# EasyEDA Pro project balance_car.eprj, schematic Schematic1
Board Name: 1_控制板_2; Create Date: 2024-08-28; Page Name: P1; Project Name: balance_car; Schematic Name: Schematic1_2; Update Date: 2024-08-28
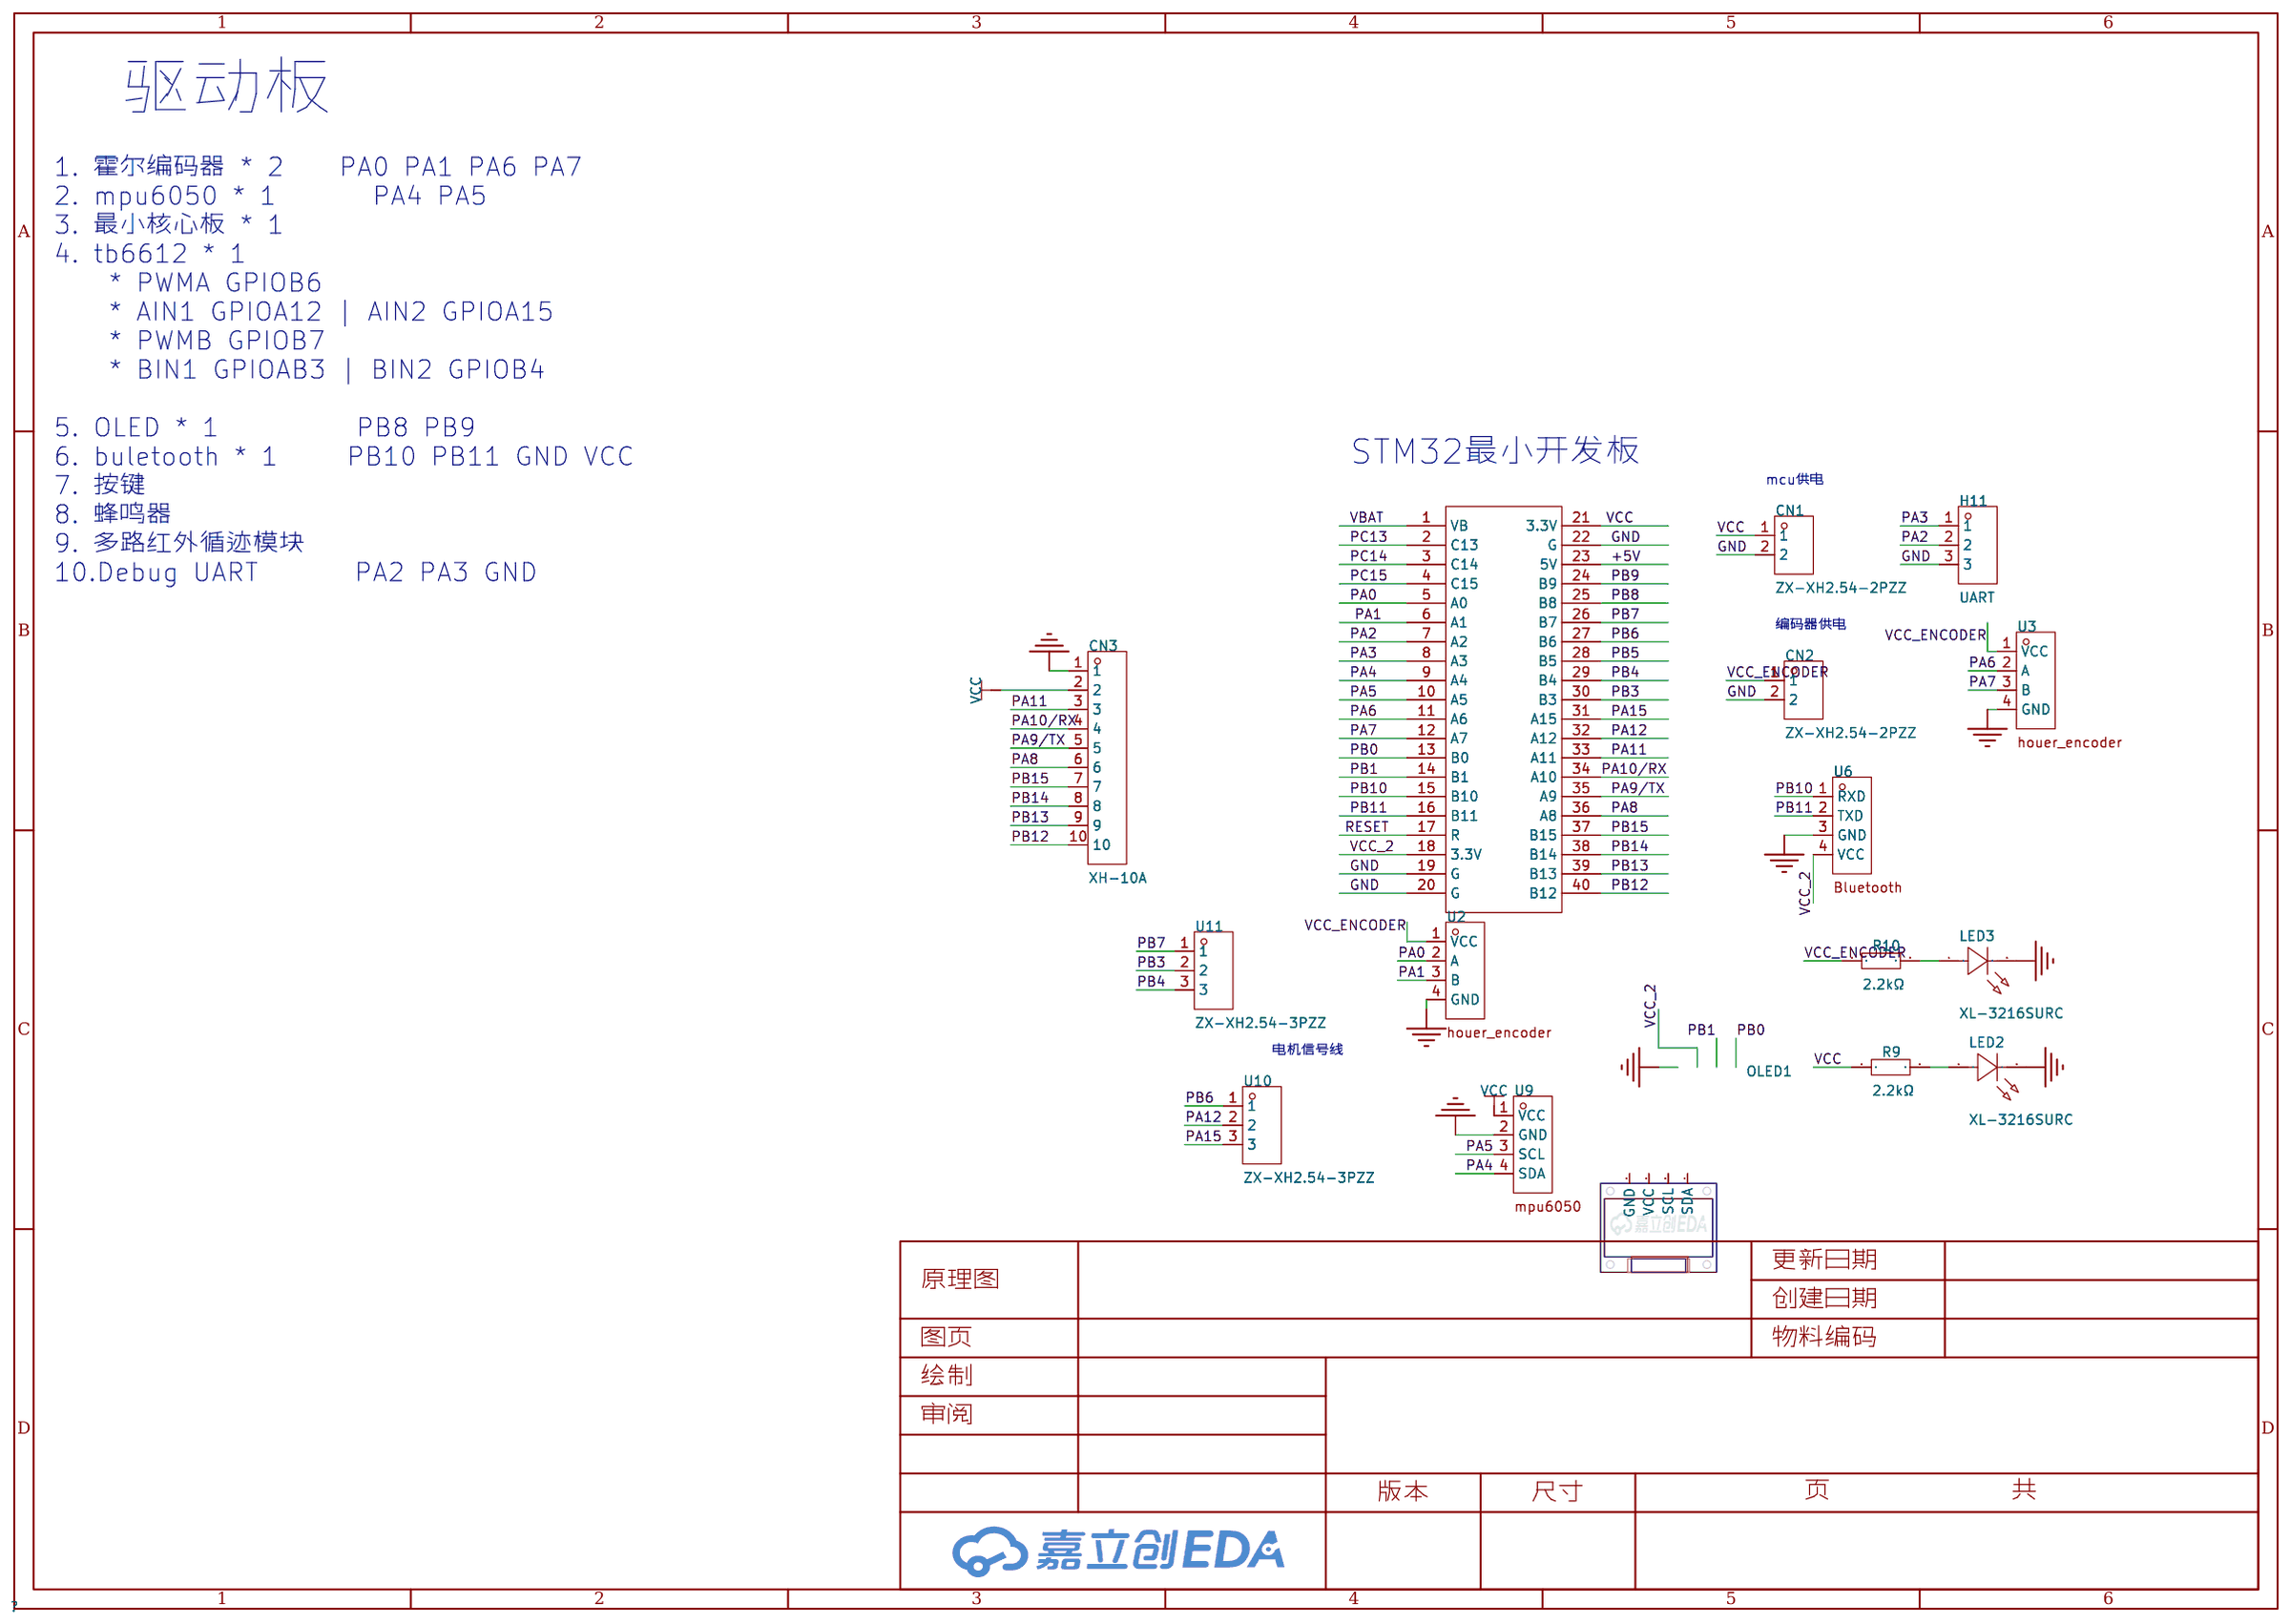
[diagram p3: schematic sheet]

## Parts
CN1  ZX-XH2.54-2PZZ  [CONN-TH_2P-P2.50_HX25003-2A]
CN2  ZX-XH2.54-2PZZ  [CONN-TH_2P-P2.50_HX25003-2A]
CN3  XH-10A  [CONN-TH_10P-P2.50_HCTL_XH-10A]
H11  UART  [HDR-TH_3P-P2.54-V-M]
LED2  XL-3216SURC  [LED1206-R-RD_RED]
LED3  XL-3216SURC  [LED1206-R-RD_RED]
OLED1  -  [0.96OLED_4P]
R9  2.2kΩ  [R0805]
R10  2.2kΩ  [R0805]
S  -  [stm32最小开发板]
U2  -  [houer_encoder]
U3  -  [houer_encoder]
U6  -  [bluetooth]
U9  -  [mpu6050_1]
U10  ZX-XH2.54-3PZZ  [CONN-TH_3P-P2.54_2501S-3P]
U11  ZX-XH2.54-3PZZ  [CONN-TH_3P-P2.54_2501S-3P]

## Library data of the parts
CN1 CN2 = ZX-XH2.54-2PZZ: 插针结构:1x2P;间距:2.54mm;安装方式:直插;参考系列:XH;总PIN数:2P;排数:1;每排PIN数:2;行距:-;额定电流:3A;触头材质:黄铜;触头镀层:锡;工作温度范围:-25℃~+85℃;; Supplier Part: C7429632; Manufacturer: Megastar(兆星); Supplier Footprint: 插件,P=2.54mm; JLCPCB Part Class: 扩展库; Datasheet: https://atta.szlcsc.com/upload/public/pdf/source/20230619/19BA6947230AA44A04D3EDD65E618FD0.pdf; Supplier: LCSC; Pins Structure: 1x2P; Pitch: 2.54mm; Mounting Style: 直插; Reference Series: XH; Number of Pins: 2P; Number of Rows: 1; Number of PINs Per Row: 2; Current Rating (Max): 3A; Contact Material: 黄铜; Contact Plating: 锡; Operating Temperature Range: -25℃~+85℃
CN3 = XH-10A: LCSC Part Name: 1x10P 间距:2.5mm 直插 系列:XH; Supplier Part: C2908608; Manufacturer: HCTL(华灿天禄); Supplier Footprint: 插件,P=2.5mm; JLCPCB Part Class: 扩展库; Datasheet: https://atta.szlcsc.com/upload/public/pdf/source/20230711/68D365716984B4AFE576D1D73D61B465.pdf; Supplier: LCSC; Pins Structure: 1x10P; Pitch: 2.5mm; Mounting Style: 直插; Reference Series: XH; Number of Pins: 10P; Number of Rows: 1; Number of PINs Per Row: 10; Current Rating (Max): 3A; Contact Material: 黄铜; Contact Plating: 锡; Operating Temperature Range: -25℃~+85℃
H11 = PZ254V-11-03P: 插针结构:1x3P;间距:2.54mm;行距:-;圆针/方针:方针;安装类型:直插;排数:单排;总PIN位数:3P;额定电流:3A;额定电压:250V;配合针长度:6mm;塑高:2.5mm;端接针长度:3mm;工作温度范围:-40℃~+105℃;颜色:黑色;; LCSC Part Name: 间距:2.54mm 1x3P 直插 方针; Supplier Part: C2937625; Manufacturer: XFCN(兴飞); Supplier Footprint: 插件,P=2.54mm; JLCPCB Part Class: 扩展库; Datasheet: https://atta.szlcsc.com/upload/public/pdf/source/20200309/C492402_8335C3D49C4E4C618838D59BB1D024C1.pdf; Supplier: LCSC; Pin Structure: 1x3P; Pitch: 2.54mm; Circluar Pins/Square Pins: 方针; Mounting Type: 直插; Number of Rows: 单排; Number of Pins: 3P; Current Rating (Max): 3A; Voltage Rating (Max): 250V; Length of Mating Pin: 6mm; Insulation Height: 2.5mm; Length of End Connection Pin: 3mm; Operating Temperature Range: -40℃~+105℃; Color: 黑色
LED2 LED3 = XL-3216SURC: Supplier Part: C965822; Manufacturer: XINGLIGHT(成兴光); Supplier Footprint: 1206; JLCPCB Part Class: 扩展库; Datasheet: https://atta.szlcsc.com/upload/public/pdf/source/20221102/38B682A5E5FDBBFCA7077B6272CE8E6F.pdf; Supplier: LCSC; Emitted Color: 红色; Power Dissipation: 55mW; Forward Current: 25mA; Dominant Wavelength: 617nm~621nm; Peak Wavelength: 623nm; Lens Color: 无色透明透镜; Viewing Angle: 120°; Mounting Sytle: 正贴; Operating Temperature: -30℃~+85℃
OLED1 = 0.96OLED模块_4P: Supplier Footprint: 插件
R9 R10 = 0805W8F2201T5E: 阻值:2.2kΩ;精度:±1%;功率:125mW;温度系数:±100ppm/℃;电阻类型:厚膜电阻;; LCSC Part Name: 2.2kΩ ±1% 125mW 厚膜电阻; Supplier Part: C17520; Manufacturer: UNI-ROYAL(厚声); Supplier Footprint: 0805; JLCPCB Part Class: 基础库; Datasheet: https://atta.szlcsc.com/upload/public/pdf/source/20200306/C422600_1E6D84923E4A46A82E41ADD87F860B5C.pdf; Supplier: LCSC; Tolerance: ±1%; Power(Watts): 125mW; Overload Voltage (Max): 150V; Temperature Coefficient: ±100ppm/℃; Type: 厚膜电阻; Operating Temperature Range: -55℃~+155℃
S = Stm32最小开发板
U2 U3 = huoer_encoder
U6 = bluetooth
U9 = mpu6050_1
U10 U11 = ZX-XH2.54-3PZZ: 插针结构:1x3P;间距:2.54mm;安装方式:直插;参考系列:XH;总PIN数:3P;排数:1;每排PIN数:3;行距:-;额定电流:3A;触头材质:黄铜;触头镀层:锡;工作温度范围:-25℃~+85℃;; Supplier Part: C7429633; Manufacturer: Megastar(兆星); Supplier Footprint: 插件,P=2.54mm; JLCPCB Part Class: 扩展库; Datasheet: https://atta.szlcsc.com/upload/public/pdf/source/20230619/AE17037A2CFDBE8D9CBA775D61AD0A84.pdf; Supplier: LCSC; Pins Structure: 1x3P; Pitch: 2.54mm; Mounting Style: 直插; Reference Series: XH; Number of Pins: 3P; Number of Rows: 1; Number of PINs Per Row: 3; Current Rating (Max): 3A; Contact Material: 黄铜; Contact Plating: 锡; Operating Temperature Range: -25℃~+85℃

## Nets
+5V: S.23(5V)
GND: CN1.2 CN2.2 CN3.1 H11.3 LED2.2(A) LED3.2(A) S.19(G) S.20(G) S.22(G) U2.4(GND) U3.4(GND) U6.3(GND) U9.2(GND)
VBAT: S.1(VB)
VCC: CN1.1 CN3.2 R9.1 S.21(3.3V) U9.1(VCC)
VCC_2: S.18(3.3V) U6.4(VCC)
VCC_ENCODER: CN2.1 R10.1 U2.1(VCC) U3.1(VCC)
PA0: S.5(A0) U2.2(A)
PA1: S.6(A1) U2.3(B)
PA2: H11.2 S.7(A2)
PA3: H11.1 S.8(A3)
PA4: S.9(A4) U9.4(SDA)
PA5: S.10(A5) U9.3(SCL)
PA6: S.11(A6) U3.2(A)
PA7: S.12(A7) U3.3(B)
PA8: CN3.6 S.36(A8)
PA9/TX: CN3.5 S.35(A9)
PA10/RX: CN3.4 S.34(A10)
PA11: CN3.3 S.33(A11)
PA12: S.32(A12) U10.2
PA15: S.31(A15) U10.3
PB0: S.13(B0)
PB1: S.14(B1)
PB3: S.30(B3) U11.2
PB4: S.29(B4) U11.3
PB5: S.28(B5)
PB6: S.27(B6) U10.1
PB7: S.26(B7) U11.1
PB8: S.25(B8)
PB9: S.24(B9)
PB10: S.15(B10) U6.1(RXD)
PB11: S.16(B11) U6.2(TXD)
PB12: CN3.10 S.40(B12)
PB13: CN3.9 S.39(B13)
PB14: CN3.8 S.38(B14)
PB15: CN3.7 S.37(B15)
PC13: S.2(C13)
PC14: S.3(C14)
PC15: S.4(C15)
RESET: S.17(R)
$1N8194: LED2.1(K) R9.2
$1N8288: LED3.1(K) R10.2

Not connected (* = marked no-connect by the designer): OLED1 1(GND) 2(VCC) 3(SCL) 4(SDA)

## Notes on the sheet
- 驱动板
- 1. 霍尔编码器 * 2    PA0 PA1 PA6 PA7
  2. mpu6050 * 1       PA4 PA5
  3. 最小核心板 * 1
  4. tb6612 * 1
      * PWMA GPIOB6
      * AIN1 GPIOA12 | AIN2 GPIOA15
      * PWMB GPIOB7
      * BIN1 GPIOAB3 | BIN2 GPIOB4
  5. OLED * 1          PB8 PB9
  6. buletooth * 1     PB10 PB11 GND VCC
  7. 按键
  8. 蜂鸣器
  9. 多路红外循迹模块
  10.Debug UART       PA2 PA3 GND
- STM32最小开发板
- mcu供电
- 编码器供电
- 电机信号线
